# EasyEDA Pro project RCKid3.eprj, schematic RCKid

## Sheets
1 Power: Board Name: RCKid; Create Date: 2023-09-18; Page Name: Power; Project Name: RCKid3; Schematic Name: RCKid; Update Date: 2025-01-19; Company: EasyEDA.com; Drawed: EasyEDAPro; Page Size: A4; Part Number: JLCPCB-002; Reviewed: EasyEDAPro; Version: V0.1
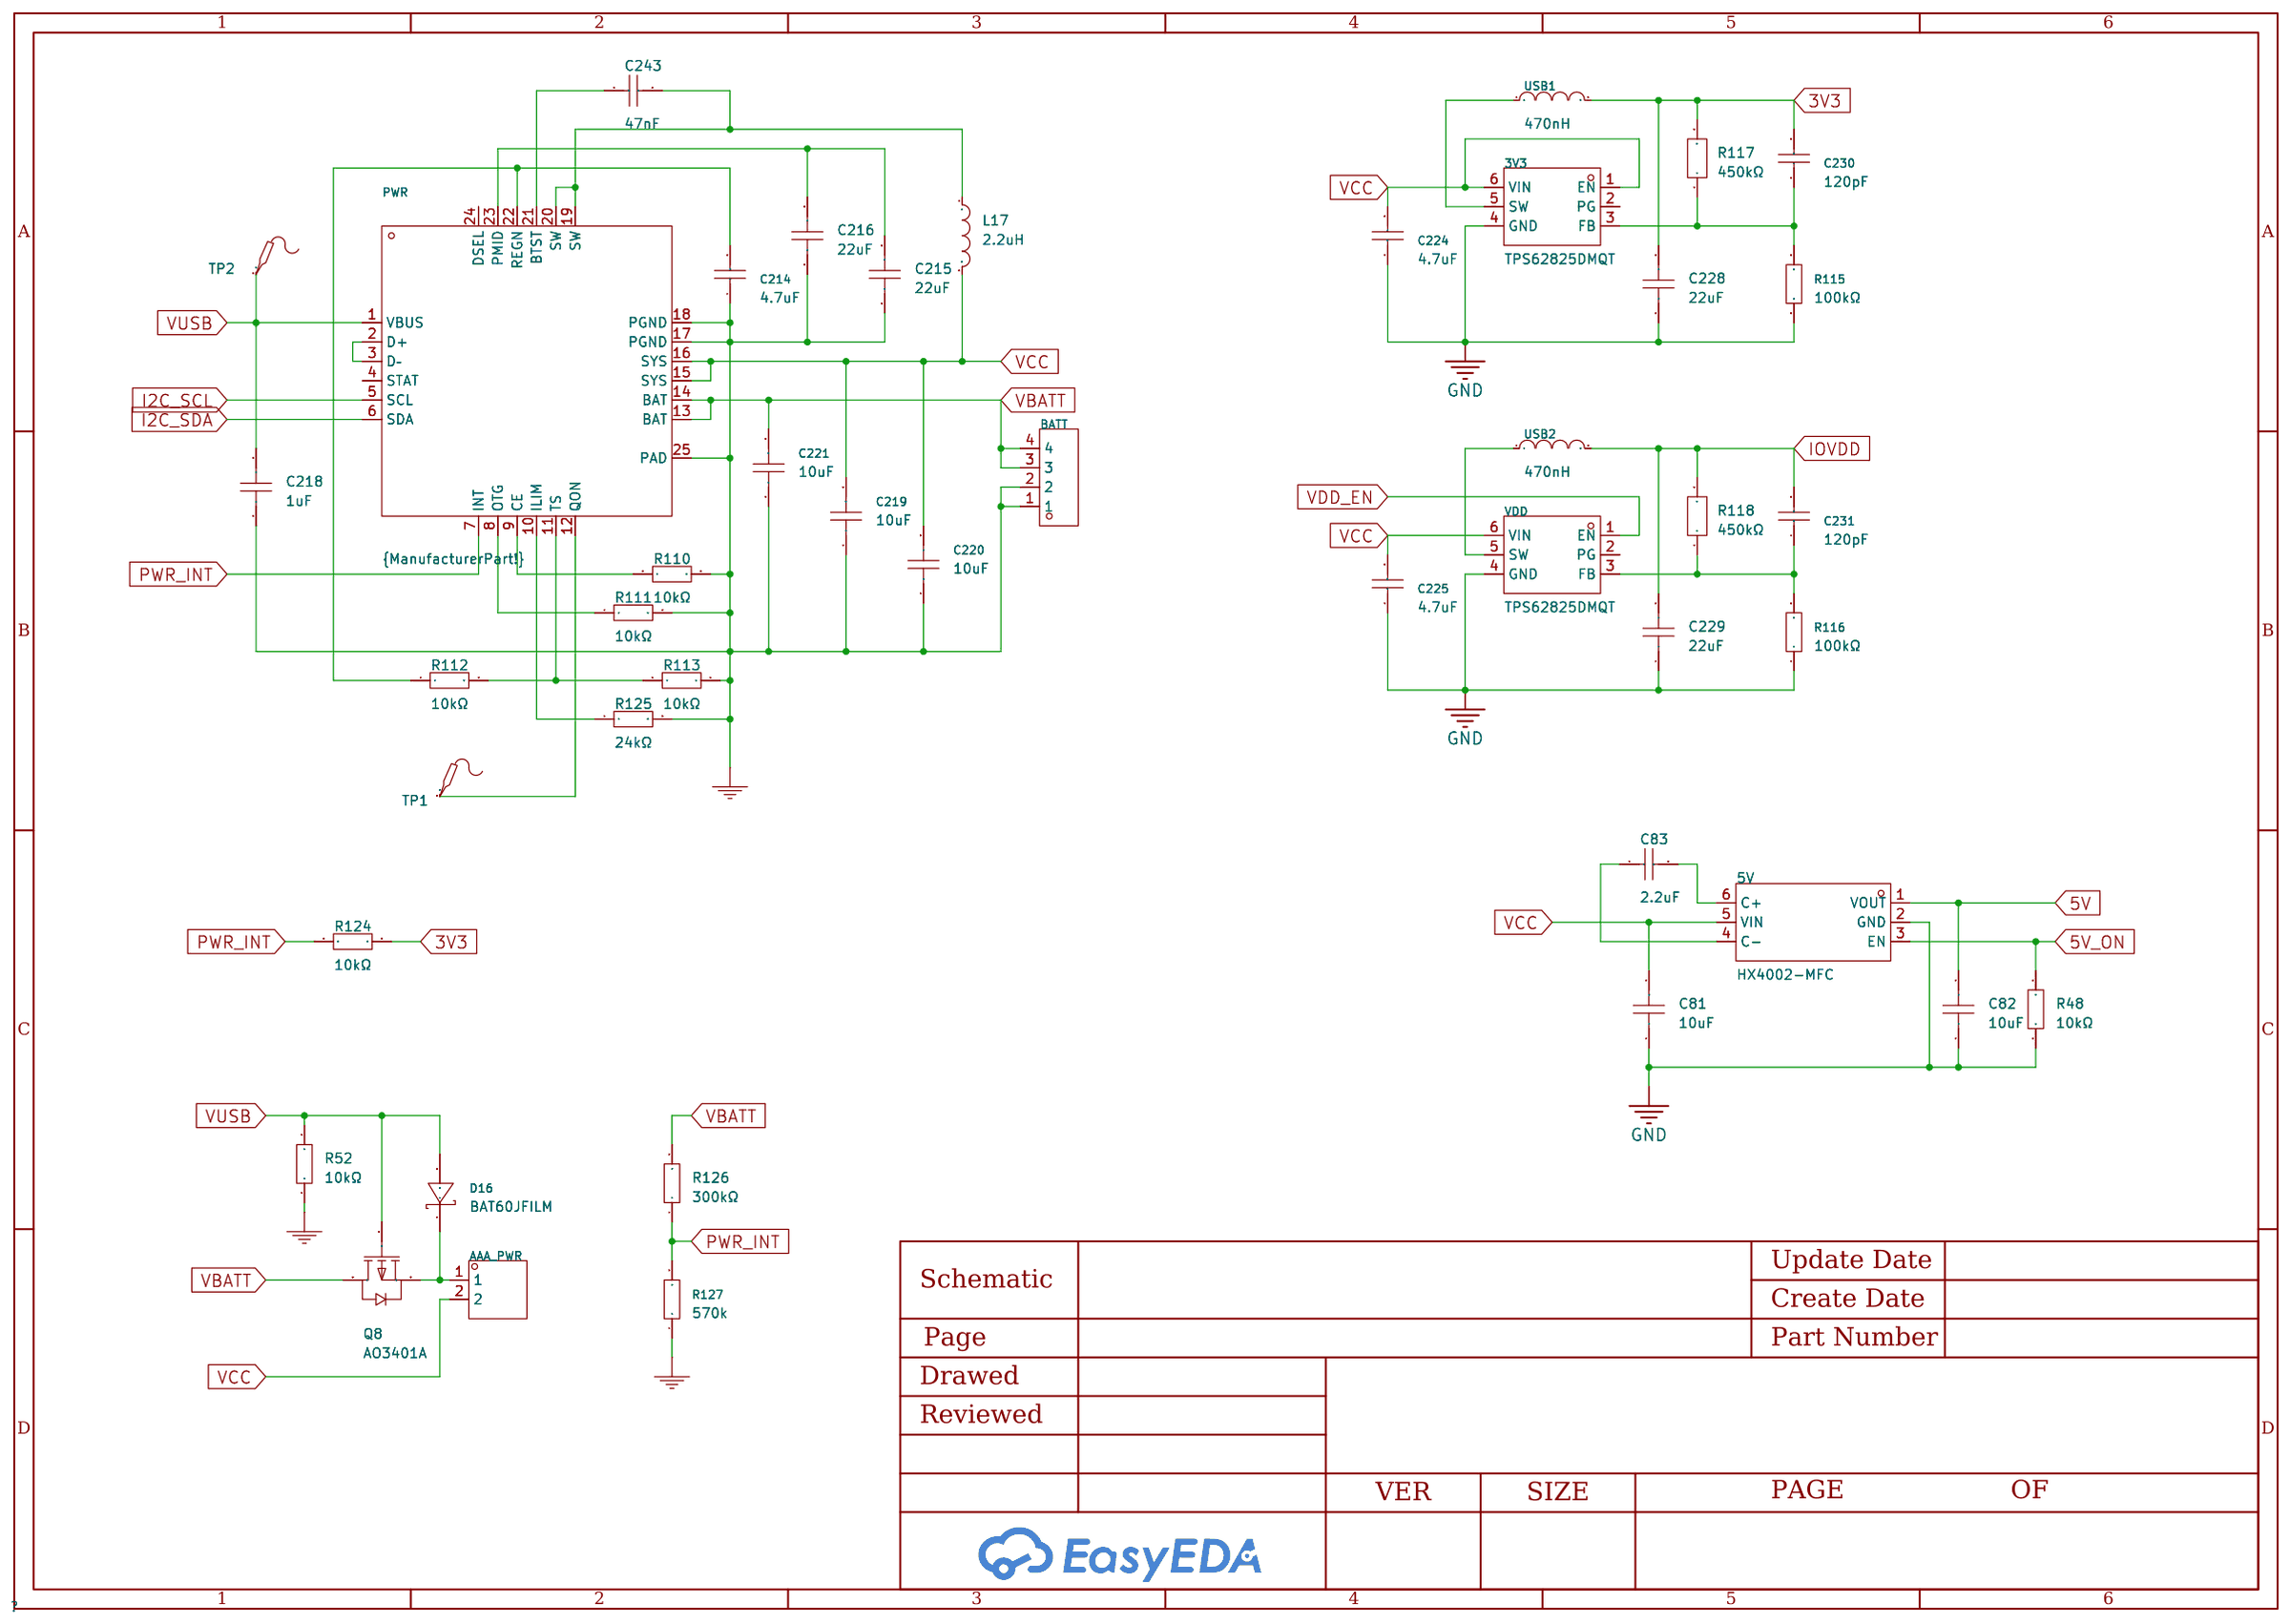
[diagram p3: Power]
2 Logic: Page Name: Logic; Update Date: 2025-01-14
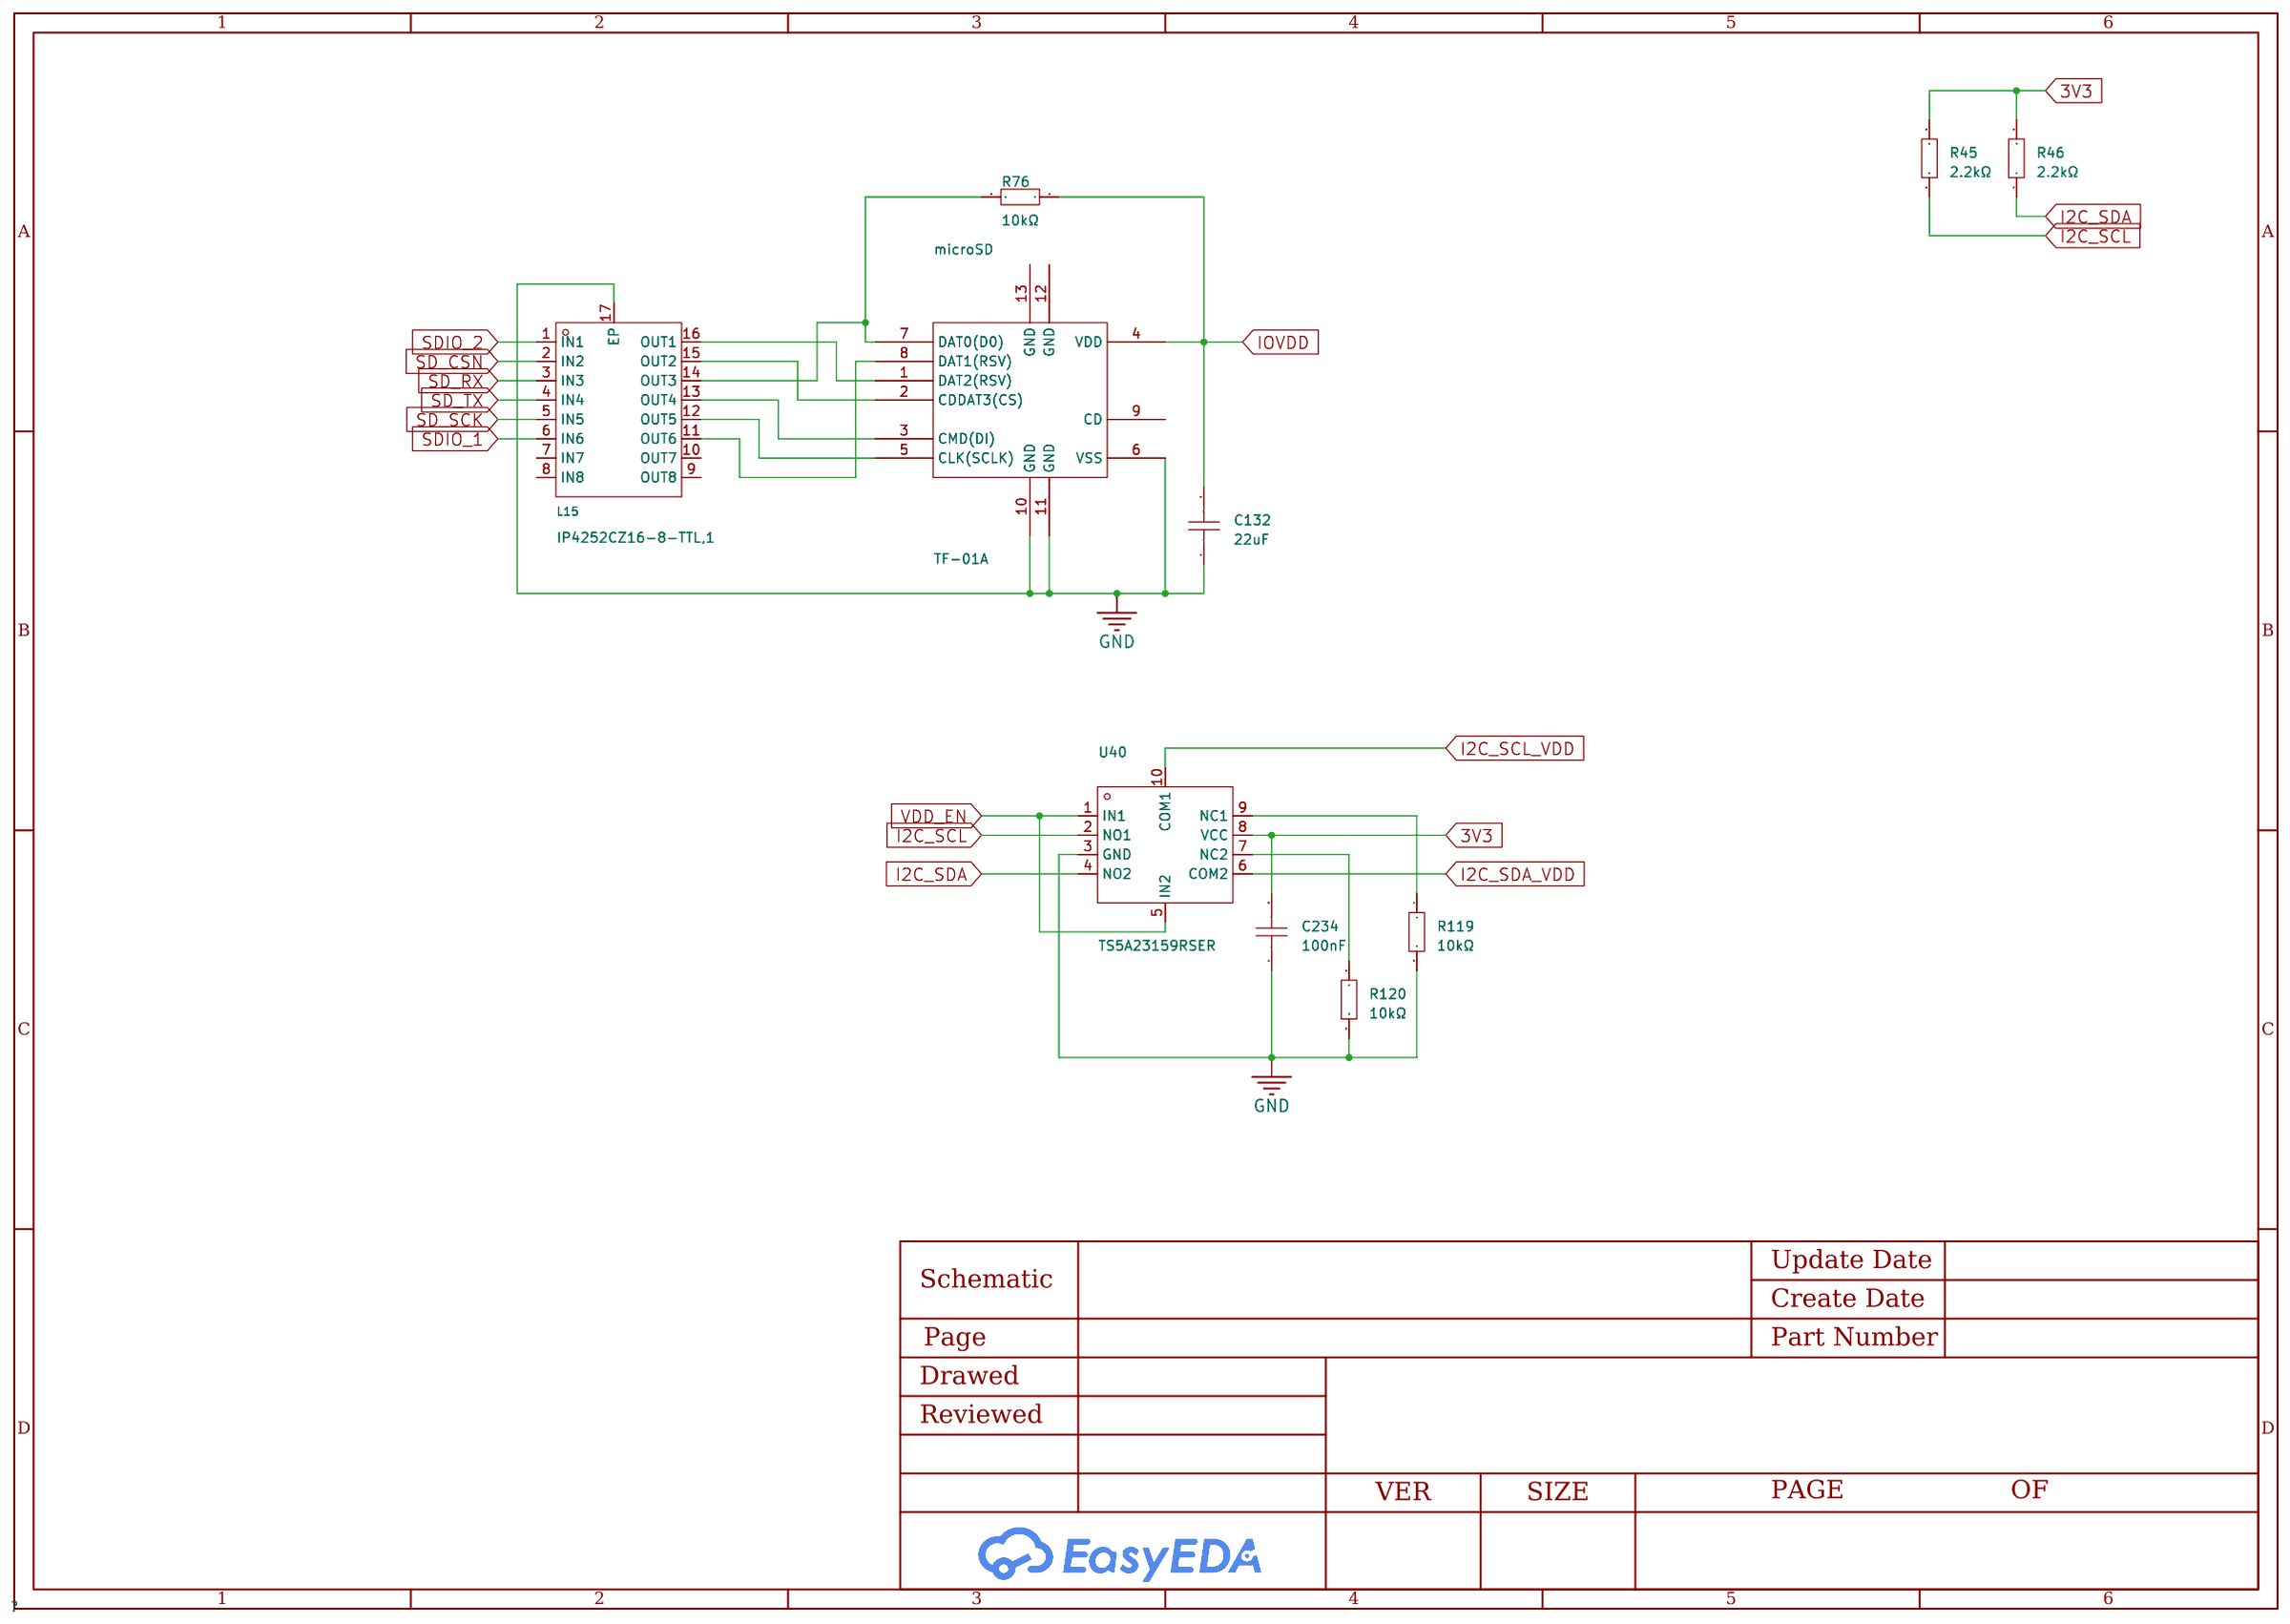
[diagram p4: Logic]
3 Audio: Page Name: Audio; Update Date: 2025-01-20
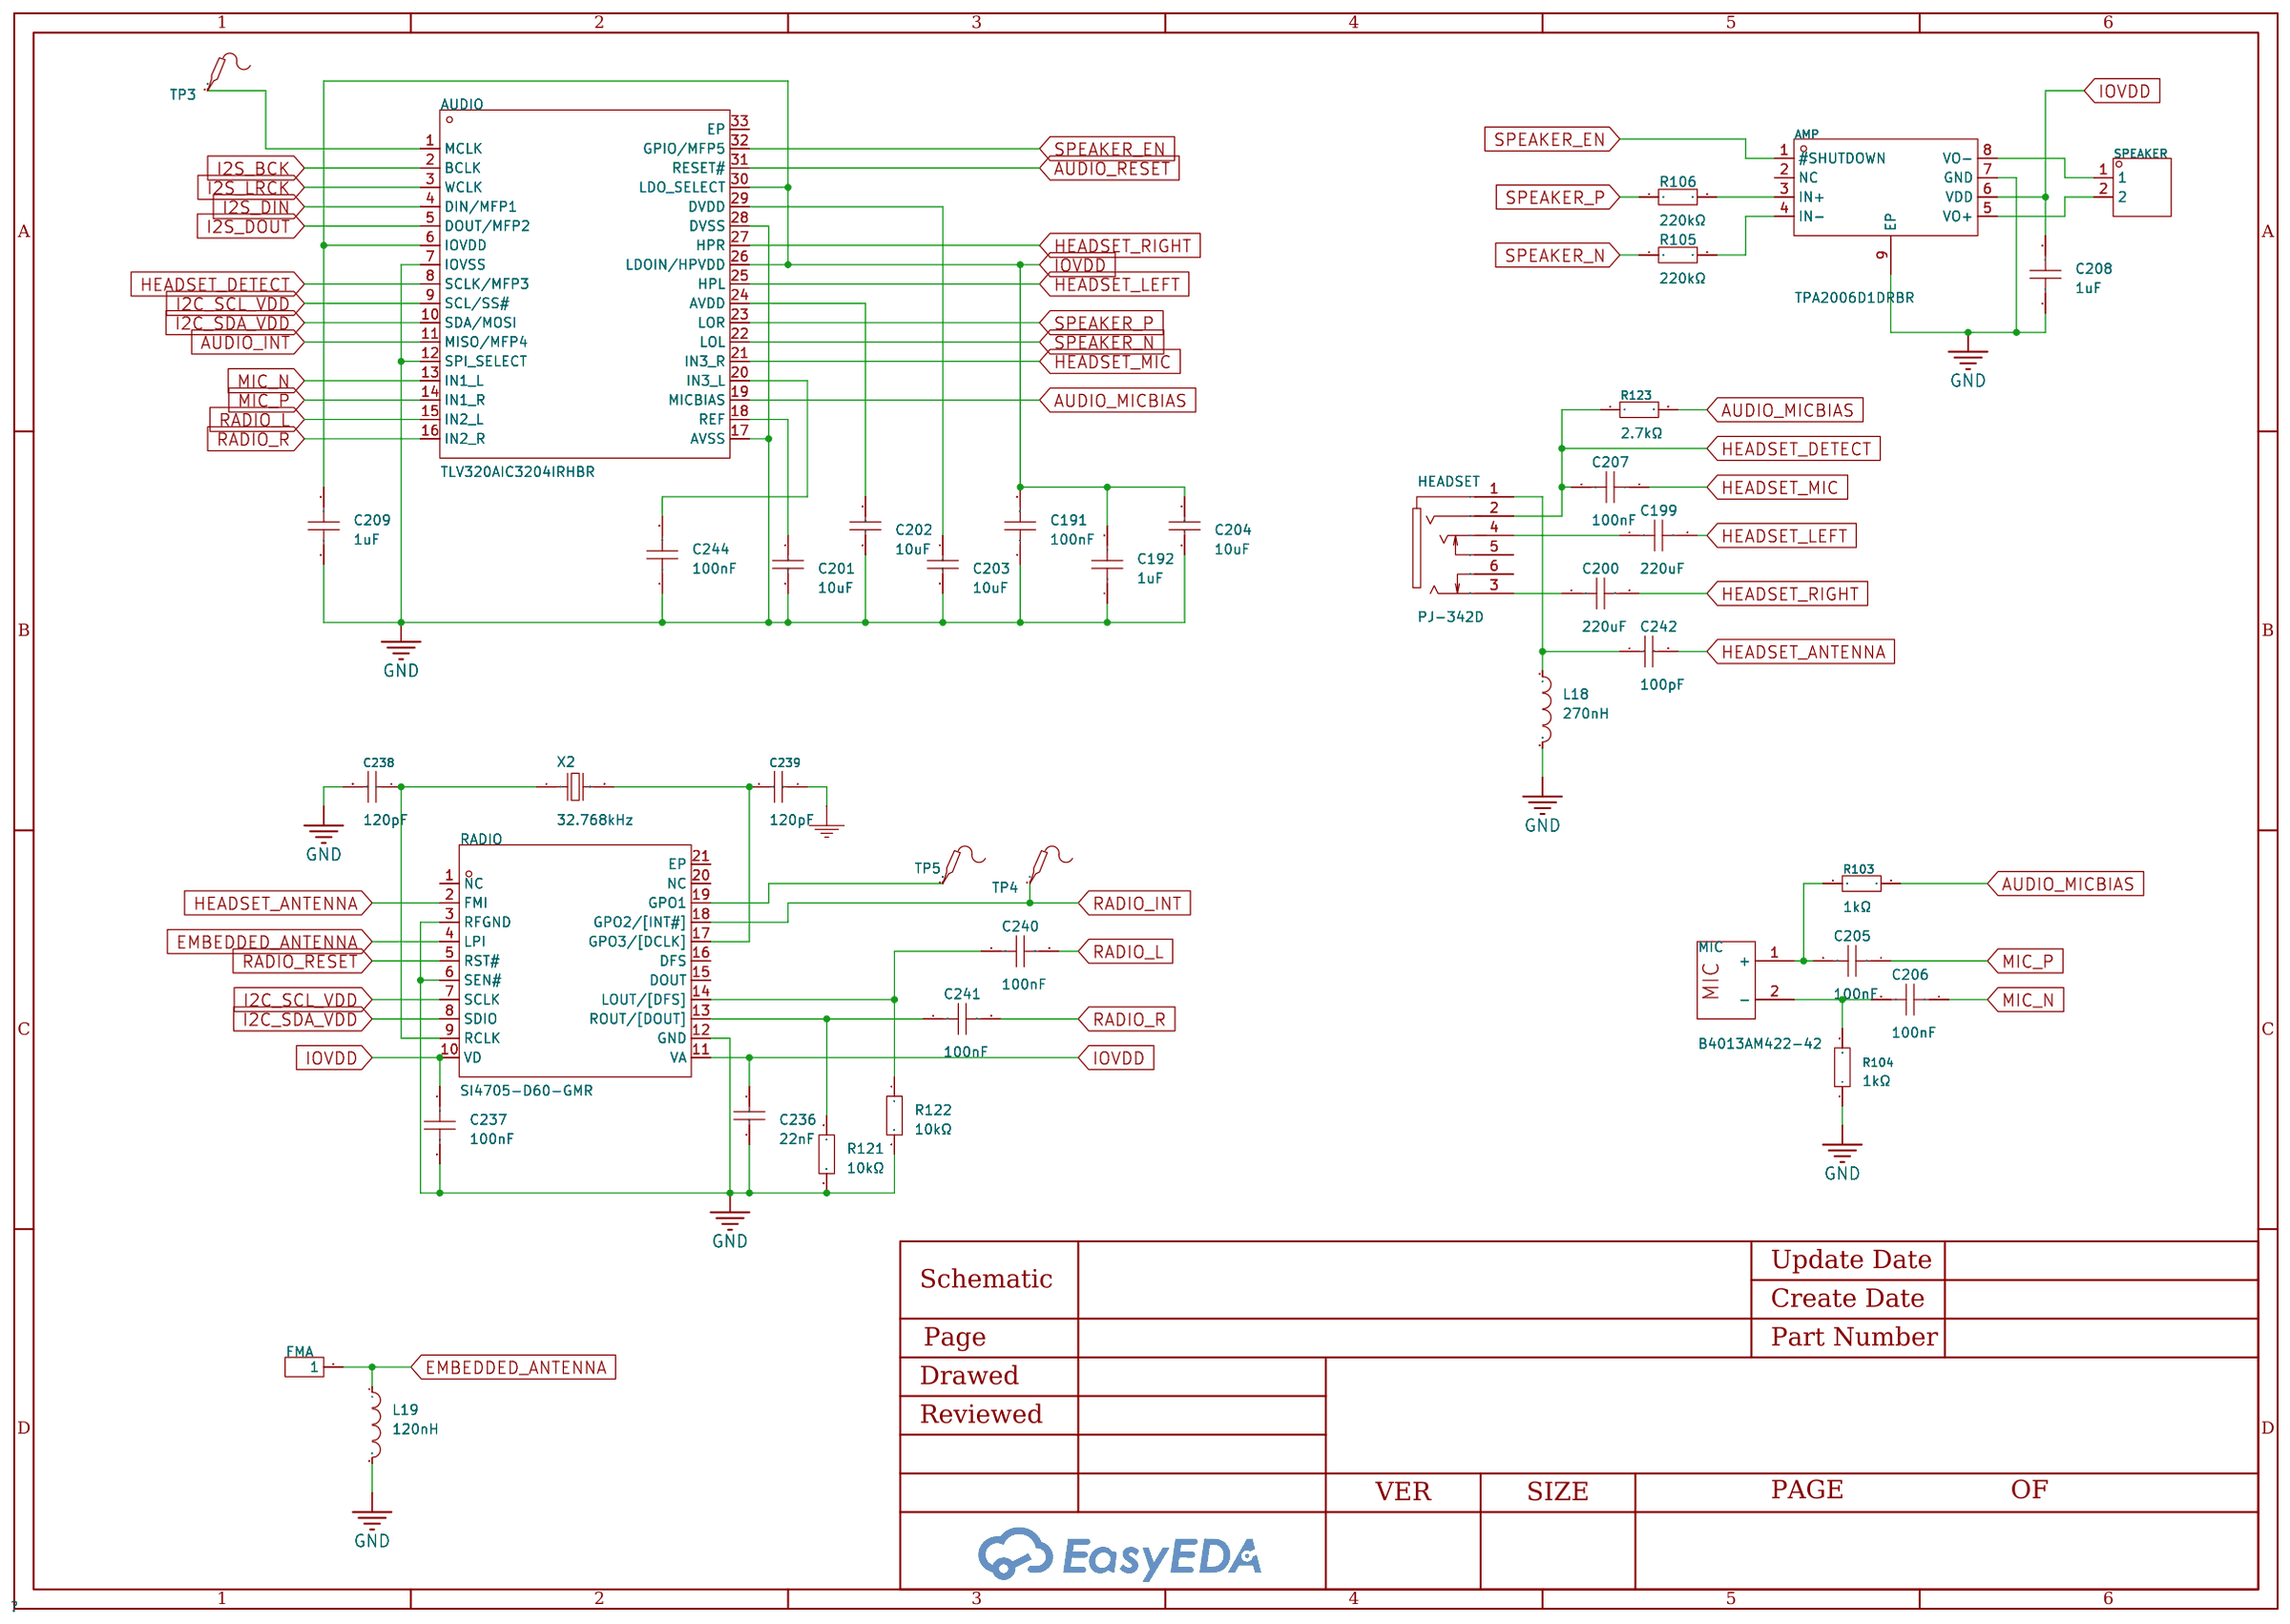
[diagram p5: Audio]
4 IO: Page Name: IO; Update Date: 2025-01-20
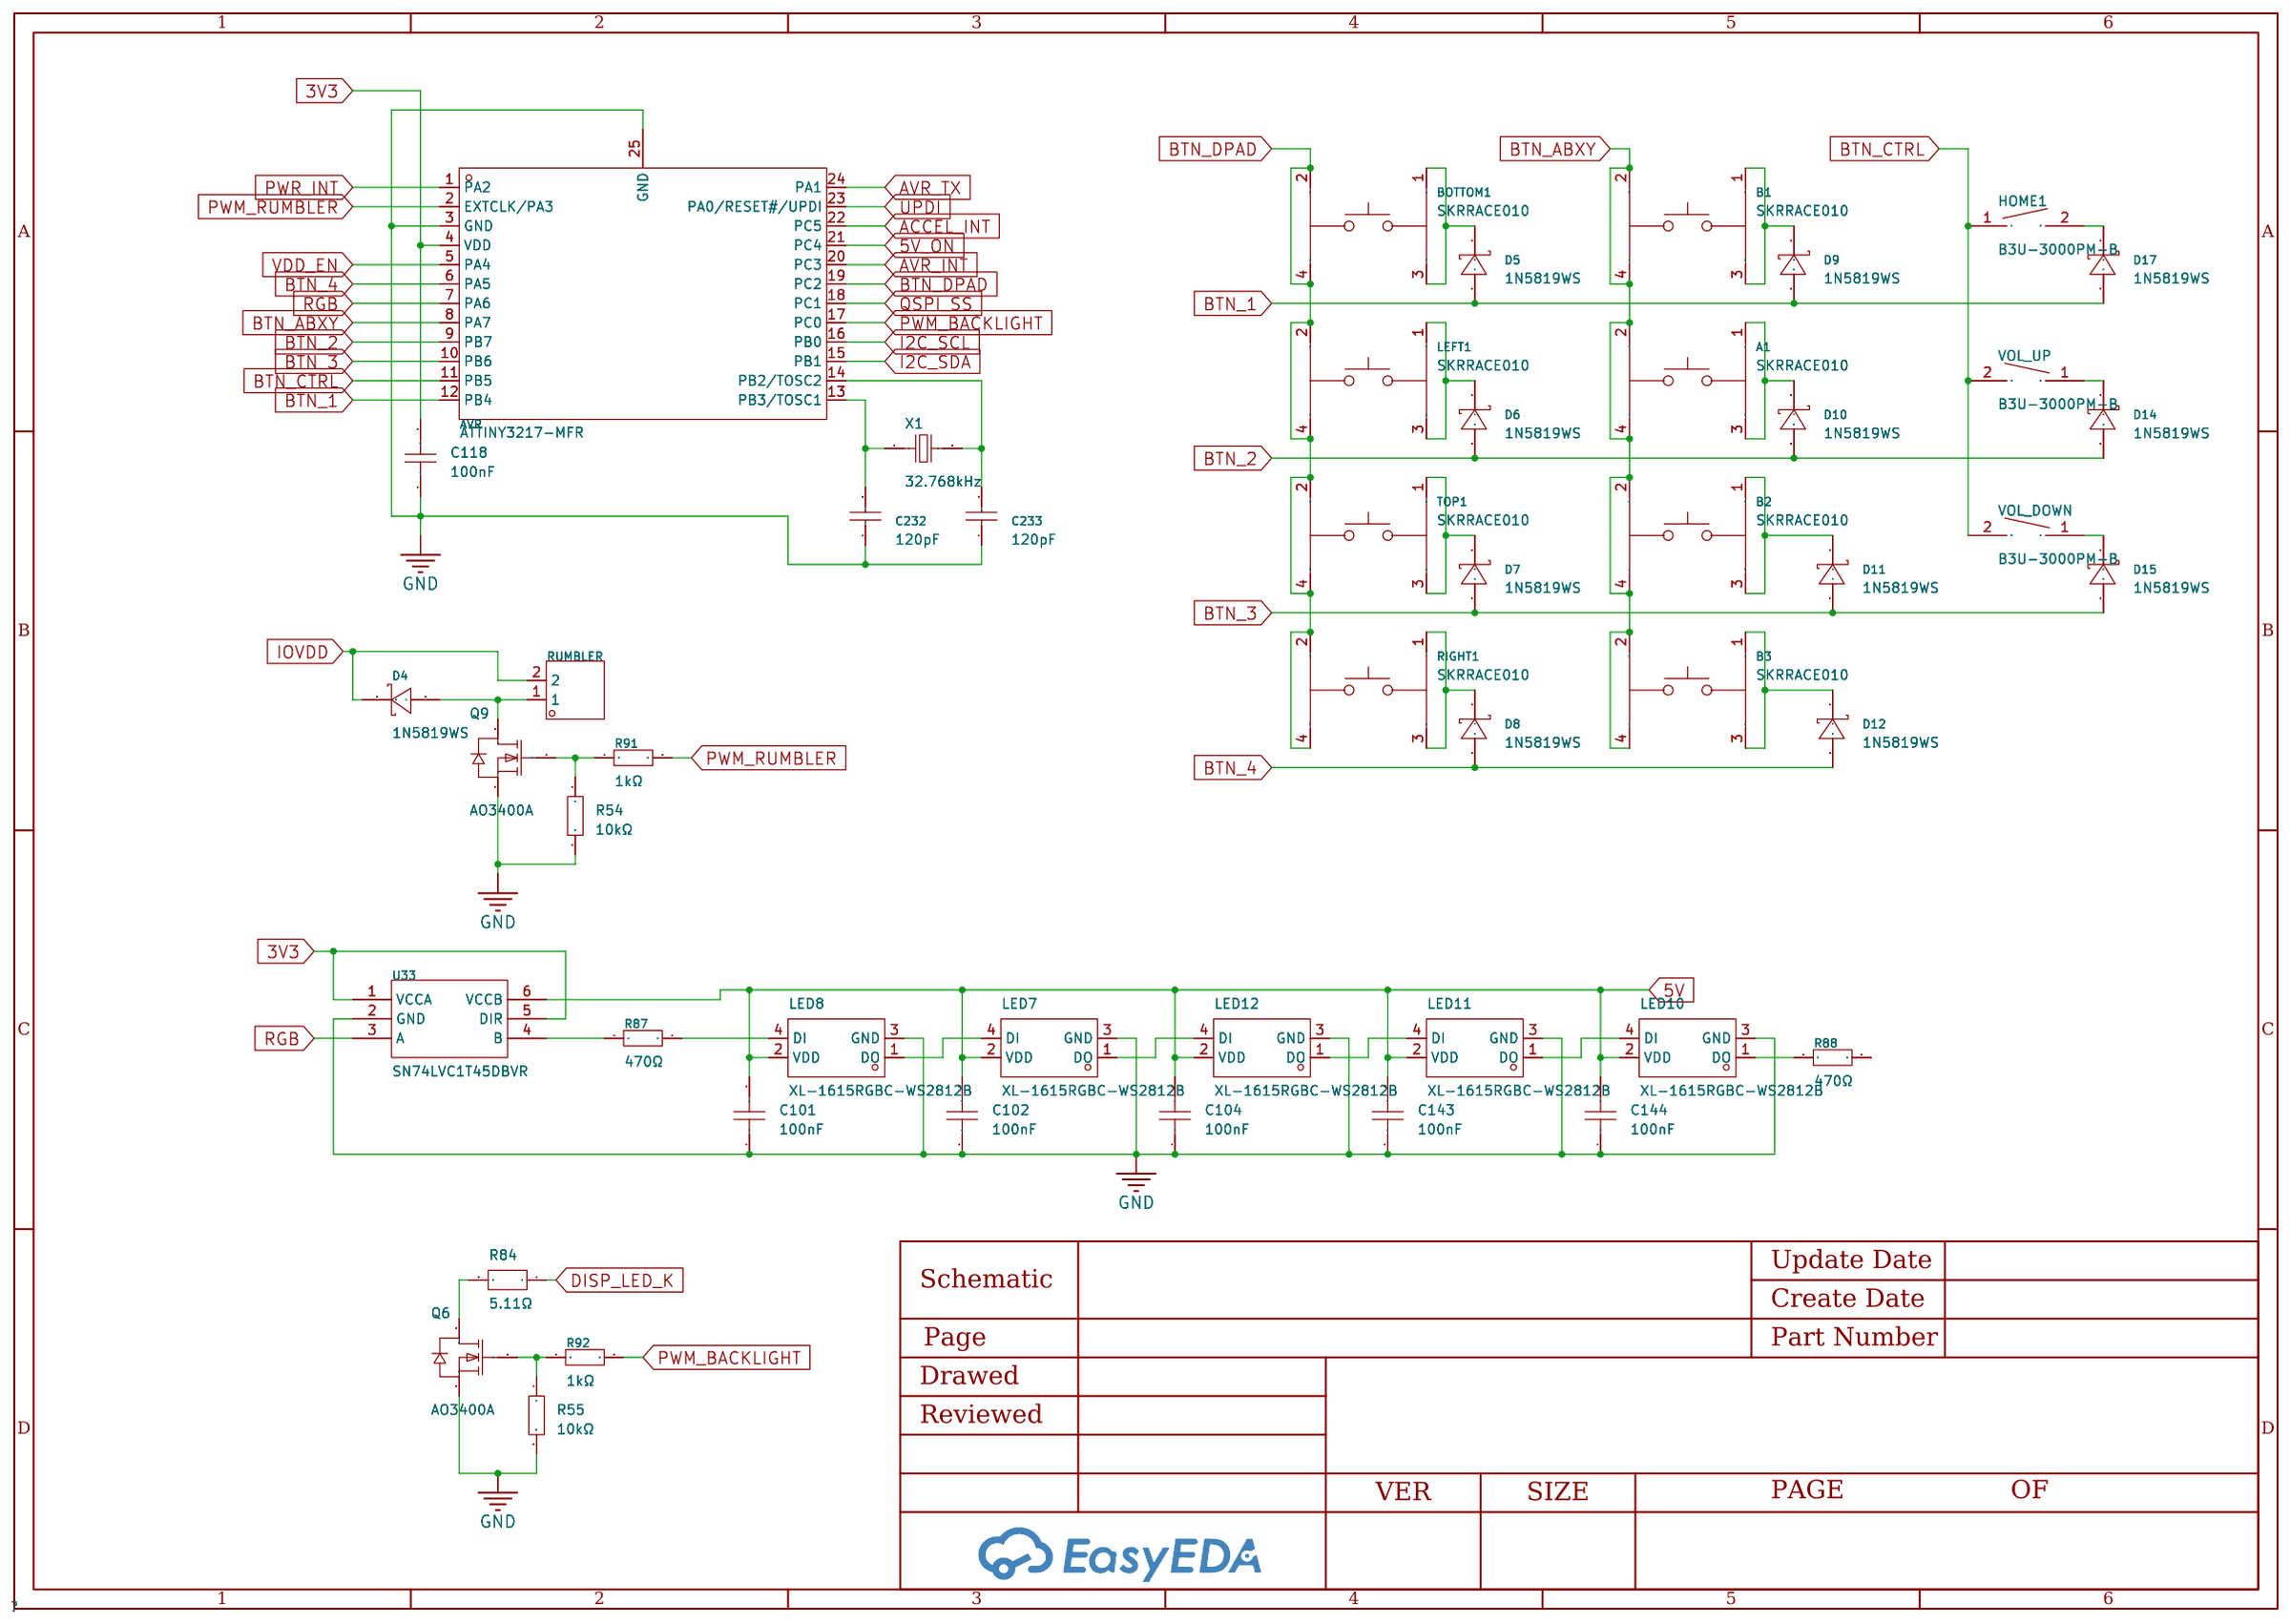
[diagram p6: IO]
5 Sensors: Page Name: Sensors; Update Date: 2025-01-01